# EasyEDA Pro project 一堆模块~.eprj

# Schematic Schematic1
Create Date: 2024-07-19; Page Name: P1; Project Name: 一堆模块~; Schematic Name: Schematic1; Update Date: 2024-07-19; Company: 嘉立创EDA; Page Size: A4; Version: V1.0
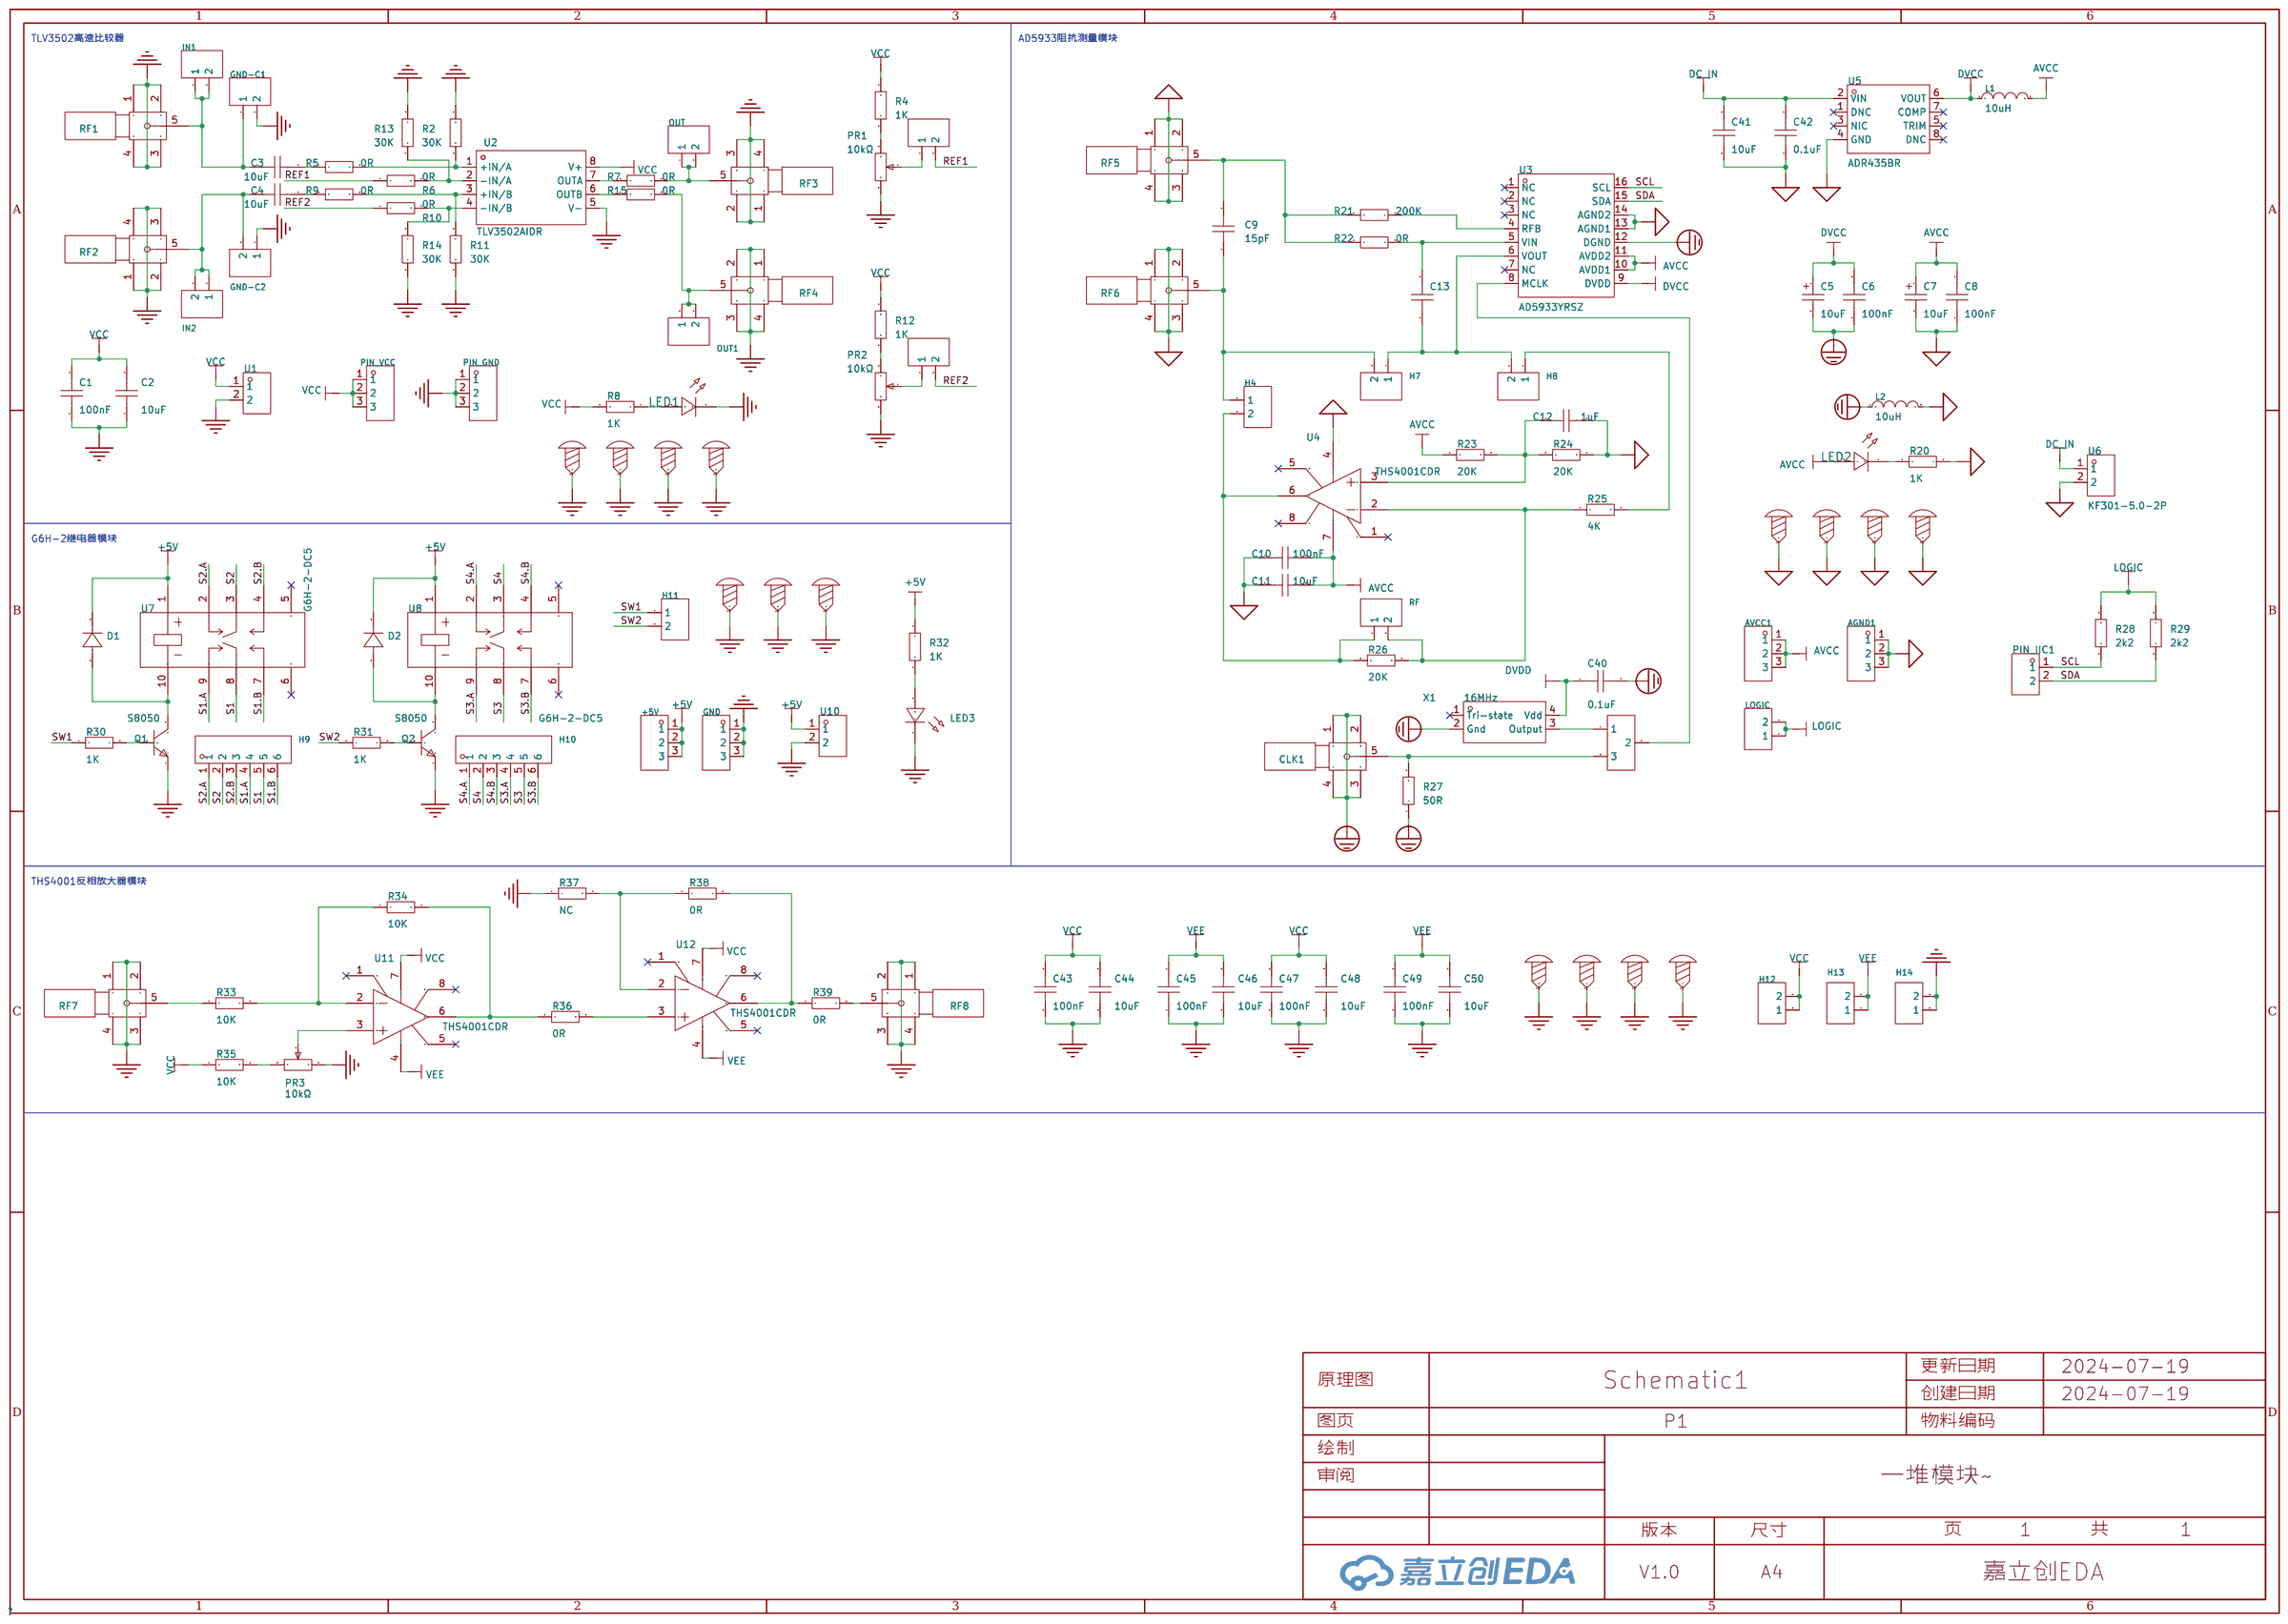
[diagram p0: schematic sheet]

## Parts
+5V  -  [HDR-TH_3P-P2.54-V-F]
AGND1  -  [HDR-TH_3P-P2.54-V-F]
AVCC1  -  [HDR-TH_3P-P2.54-V-F]
C1  100nF  [C0603]
C2  10uF  [C0603]
C3  10uF  [C0603]
C4  10uF  [C0603]
C5  10uF  [CAP-SMD_L3.2-W1.6-RD-C7171]
C6  100nF  [C0603]
C7  10uF  [CAP-SMD_L3.2-W1.6-RD-C7171]
C8  100nF  [C0603]
C9  15pF  [C0603]
C10  100nF  [C0603]
C11  10uF  [C0603]
C12  1uF  [C0603]
C13  100nF  [C0603]
C40  0.1uF  [C0603]
C41  10uF  [C0603]
C42  0.1uF  [C0603]
C43  100nF  [C0603]
C44  10uF  [C0603]
C45  100nF  [C0603]
C46  10uF  [C0603]
C47  100nF  [C0603]
C48  10uF  [C0603]
C49  100nF  [C0603]
C50  10uF  [C0603]
CLK1  BWSMA-KE-Z001  [SMA-TH_BWSMA-KE-Z001]
D1  -  [DO_1N4007]
D2  -  [DO_1N4007]
GND  -  [HDR-TH_3P-P2.54-V-F]
GND-C1  -  [HDR-TH_2P-P2.54-V-F]
GND-C2  -  [HDR-TH_2P-P2.54-V-F]
H1  -  [HDR-TH_2P-P2.54-V-F]
H2  -  [HDR-TH_2P-P2.54-V-F]
H4  -  [HDR-TH_2P-P2.54-V-F]
H6  2.54-1*3P针  [HDR-TH_3P-P2.54-V-M-1]
H7  -  [HDR-TH_2P-P2.54-V-F]
H8  -  [HDR-TH_2P-P2.54-V-F]
H9  -  [HDR-TH_6P-P2.54-V-F]
H10  -  [HDR-TH_6P-P2.54-V-F]
H11  -  [HDR-TH_2P-P2.54-V-F]
H12  -  [HDR-TH_2P-P2.54-V-F]
H13  -  [HDR-TH_2P-P2.54-V-F]
H14  -  [HDR-TH_2P-P2.54-V-F]
IN1  -  [HDR-TH_2P-P2.54-V-F]
IN2  -  [HDR-TH_2P-P2.54-V-F]
L1  10uH  [L0603]
L2  10uH  [L0603]
LED1  -  [LED_0603]
LED2  -  [LED_0603]
LED3  -  [LED_TH-3mm]
LOGIC  -  [HDR-TH_2P-P2.54-V-F]
OUT  -  [HDR-TH_2P-P2.54-V-F]
OUT1  -  [HDR-TH_2P-P2.54-V-F]
PIN_GND  -  [HDR-TH_3P-P2.54-V-F]
PIN_IIC1  ZX-XH2.54-2PZZ  [CONN-TH_2P-P2.50_HX25003-2A]
PIN_VCC  -  [HDR-TH_3P-P2.54-V-F]
PR1  10kΩ  [R_3296]
PR2  10kΩ  [R_3296]
PR3  10kΩ  [R_3296]
Q1  S8050  [TO-92-3_L4.5-W3.5-P1.27-L]
Q2  S8050  [TO-92-3_L4.5-W3.5-P1.27-L]
R2  30K  [R0603]
R4  1K  [R0603]
R5  0R  [R0603]
R6  0R  [R0603]
R7  0R  [R0603]
R8  1K  [R0603]
R9  0R  [R0603]
R10  0R  [R0603]
R11  30K  [R0603]
R12  1K  [R0603]
R13  30K  [R0603]
R14  30K  [R0603]
R15  0R  [R0603]
R20  1K  [R0603]
R21  200K  [R0603]
R22  0R  [R0603]
R23  20K  [R0603]
R24  20K  [R0603]
R25  4K  [R0603]
R26  20K  [R0603]
R27  50R  [R0603]
R28  2k2  [R0603]
R29  2k2  [R0603]
R30  1K  [Res_1/4W]
R31  1K  [Res_1/4W]
R32  1K  [Res_1/4W]
R33  10K  [R0603]
R34  10K  [R0603]
R35  10K  [R0603]
R36  0R  [R0603]
R37  NC  [R0603]
R38  0R  [R0603]
R39  0R  [R0603]
RF  -  [HDR-TH_2P-P2.54-V-F]
RF1  BWSMA-KE-Z001  [SMA-TH_BWSMA-KE-Z001]
RF2  BWSMA-KE-Z001  [SMA-TH_BWSMA-KE-Z001]
RF3  BWSMA-KE-Z001  [SMA-TH_BWSMA-KE-Z001]
RF4  BWSMA-KE-Z001  [SMA-TH_BWSMA-KE-Z001]
RF5  BWSMA-KE-P001  [SMA-SMD_BWSMA-KE-P001]
RF6  BWSMA-KE-P001  [SMA-SMD_BWSMA-KE-P001]
RF7  BWSMA-KE-P001  [SMA-SMD_BWSMA-KE-P001]
RF8  BWSMA-KE-P001  [SMA-SMD_BWSMA-KE-P001]
TP1  -  [M3螺丝]
TP2  -  [M3螺丝]
TP3  -  [M3螺丝]
TP4  -  [M3螺丝]
TP5  -  [M3螺丝]
TP6  -  [M3螺丝]
TP7  -  [M3螺丝]
TP8  -  [M3螺丝]
TP9  -  [M3螺丝]
TP10  -  [M3螺丝]
TP12  -  [M3螺丝]
TP13  -  [M3螺丝]
TP14  -  [M3螺丝]
TP15  -  [M3螺丝]
TP16  -  [M3螺丝]
U1  KF301-5.0-2P  [CONN-TH_P5.00_KF301-5.0-2P]
U2  TLV3502AIDR  [SOIC-8_L4.9-W3.9-P1.27-LS6.0-BL]
U3  AD5933YRSZ  [SSOP-16_L6.2-W5.3-P0.65-LS7.8-BL]
U4  THS4001CDR  [SOIC-8_L4.9-W3.9-P1.27-LS6.0-BL]
U5  ADR435BR  [SOIC-8_L4.9-W3.9-P1.27-LS6.0-BL]
U6  KF301-5.0-2P  [CONN-TH_P5.00_KF301-5.0-2P]
U7  G6H-2-DC5  [RELAY-TH_G6H-2]
U8  G6H-2-DC5  [RELAY-TH_G6H-2]
U10  KF301-5.0-2P  [CONN-TH_P5.00_KF301-5.0-2P]
U11  THS4001CDR  [SOIC-8_L4.9-W3.9-P1.27-LS6.0-BL]
U12  THS4001CDR  [SOIC-8_L4.9-W3.9-P1.27-LS6.0-BL]
X1  16MHz  [OSC-SMD_4P-L3.2-W2.5-BL]

## Library data of the parts
+5V AGND1 AVCC1 GND PIN_GND PIN_VCC = HDR-F_2.54_1x3P: Supplier Part: C541850; Supplier Footprint: 插件
C1-C4 C6 C8-C13 C40-C50 = CAP_0603: Supplier Footprint: 0603
C5 C7 = TAJA106K016RNJ: 容值:10uF;精度:±10%;额定电压:16V;等效串联电阻:3Ω@100kHz;; LCSC Part Name: 10uF ±10% 16V; Supplier Part: C7171; Manufacturer: Kyocera AVX; Supplier Footprint: CASE-A-3216; JLCPCB Part Class: 基础库; Datasheet: https://atta.szlcsc.com/upload/public/pdf/source/20160107/1457707750344.pdf; Supplier: LCSC; Tolerance: ±10%; Rated Voltage: 16V; Equivalent Series Resistance(ESR): 3Ω@100kHz; Operating Temperature: -55℃~+125℃
CLK1 = BWSMA-KE-Z001_C496549: 连接器类型:板端;接口类型:内孔;端口数量:1;接口直径:-;接口长度/高度:-;频率-最大值:-;射频系列:SMA;阻抗:50Ω;样式:正脚;触头材质:-;触头镀层:-;工作温度范围:-65℃~+165℃;焊接温度(最大值):-;; LCSC Part Name: 内孔 SMA 正脚; Supplier Part: C496549; Manufacturer: BAT WIRELESS(蝙蝠无线); Supplier Footprint: 插件; JLCPCB Part Class: 扩展库; Datasheet: https://atta.szlcsc.com/upload/public/pdf/source/20221228/40BF41E56A06003A0210E1785CA66EA6.pdf; Supplier: LCSC; Connector Type: 板端; Interface Type: 内孔; Number of Ports: 1; RF Series: SMA; Impedance: 50Ω; Style: 正脚; Operating Temperature Range: -65℃~+165℃
D1 D2 = D_1N4007A: Supplier Footprint: DO-41
GND-C1 GND-C2 H1 H2 H4 H7 H8 H11-H14 IN1 IN2 LOGIC OUT OUT1 RF = HDR-F_2.54_1x2P: Supplier Part: C49661; Supplier Footprint: 插件
H6 = 2.54-1*3P针: 插针结构:1x3P;间距:2.54mm;行距:-;圆针/方针:方针;安装类型:直插;排数:单排;总PIN位数:3P;额定电流:3A;额定电压:-;配合针长度:-;塑高:-;端接针长度:-;触头材质:-;触头镀层:-;工作温度范围:-40℃~+105℃;颜色:黑色;; LCSC Part Name: 间距:2.54mm 1x3P 直插 方针; Supplier Part: C49257; Manufacturer: BOOMELE(博穆精密); Supplier Footprint: 插件,P=2.54mm; JLCPCB Part Class: 扩展库; Datasheet: https://atta.szlcsc.com/upload/public/pdf/source/20221018/3E9408392E35E6F57A28985E5F7BF5C9.pdf; Supplier: LCSC; Pin Structure: 1x3P; Pitch: 2.54mm; Circluar Pins/Square Pins: 方针; Mounting Type: 直插; Number of Rows: 单排; Number of Pins: 3P; Current Rating (Max): 3A; Operating Temperature Range: -40℃~+105℃; Color: 黑色
H9 H10 = HDR-F_2.54_1x6P: Supplier Part: C40877; Supplier Footprint: 插件
L1 L2 = L_0603
LED1 LED2 = LED_0603-R: Supplier Footprint: 0603
LED3 = LED_TH-R_3mm: Supplier Footprint: 插件
PIN_IIC1 = ZX-XH2.54-2PZZ: 插针结构:1x2P;间距:2.54mm;安装方式:直插;参考系列:XH;总PIN数:2P;排数:1;每排PIN数:2;行距:-;额定电流:3A;触头材质:黄铜;触头镀层:锡;工作温度范围:-25℃~+85℃;; Supplier Part: C7429632; Manufacturer: Megastar(兆星); Supplier Footprint: 插件,P=2.54mm; JLCPCB Part Class: 扩展库; Datasheet: https://atta.szlcsc.com/upload/public/pdf/source/20230619/19BA6947230AA44A04D3EDD65E618FD0.pdf; Supplier: LCSC; Pins Structure: 1x2P; Pitch: 2.54mm; Mounting Style: 直插; Reference Series: XH; Number of Pins: 2P; Number of Rows: 1; Number of PINs Per Row: 2; Current Rating (Max): 3A; Contact Material: 黄铜; Contact Plating: 锡; Operating Temperature Range: -25℃~+85℃
PR1-PR3 = R_3296: Supplier Footprint: 直插
Q1 Q2 = S8050_C2931492: 晶体管类型:NPN;集电极电流(Ic):500mA;集射极击穿电压(Vceo):25V;功率(Pd):625mW;直流电流增益(hFE@Ic,Vce):160@50mA,1V;; LCSC Part Name: NPN 电流:500mA 耐压:25V; Supplier Part: C2931492; Manufacturer: JSMSEMI(杰盛微); Supplier Footprint: TO-92-3; JLCPCB Part Class: 扩展库; Datasheet: https://atta.szlcsc.com/upload/public/pdf/source/20240105/D4E57AD221AC7DEA1E31B953388D993E.pdf; Supplier: LCSC; Transistor Type: NPN; Collector Current (Ic): 500mA; Collector-Emitter Breakdown Voltage (Vceo): 25V; Power Dissipation (Pd): 625mW; DC Current Gain (hFE@Ic,Vce): 160@50mA,1V; Transition Frequency (fT): 150MHz; Collector Cut-Off Current (Icbo): 100nA; Collector-Emitter Saturation Voltage (VCE(sat)@Ic,Ib): 600mV@500mA,50mA
R2 R4-R15 R20-R29 R33-R39 = Res_0603: Supplier Footprint: 0603
R30-R32 = Res_AXIAL-1/4W: Supplier Footprint: 轴向引线
RF1-RF4 = BWSMA-KE-Z001_C496549: 连接器类型:板端;接口类型:内孔;端口数量:1;接口直径:-;接口长度/高度:-;频率-最大值:-;射频系列:SMA;阻抗:50Ω;样式:正脚;触头材质:-;触头镀层:-;工作温度范围:-65℃~+165℃;焊接温度(最大值):-;; LCSC Part Name: 内孔 SMA 正脚; Supplier Part: C496549; Manufacturer: BAT WIRELESS(蝙蝠无线); Supplier Footprint: 插件; JLCPCB Part Class: Extended Part; Datasheet: https://atta.szlcsc.com/upload/public/pdf/source/20221228/40BF41E56A06003A0210E1785CA66EA6.pdf; Supplier: LCSC; Connector Type: 板端; Interface Type: 内孔; Number of Ports: 1; RF Series: SMA; Impedance: 50Ω; Style: 正脚; Operating Temperature Range: -65℃~+165℃
RF5-RF8 = BWSMA-KE-P001: 连接器类型:板端;接口类型:内孔;端口数量:1;接口直径:5.2mm;接口长度/高度:-;频率-最大值:-;射频系列:SMA;阻抗:50Ω;样式:偏脚;工作温度范围:-;; LCSC Part Name: 内孔 SMA 偏脚; Supplier Part: C496550; Manufacturer: BAT WIRELESS(蝙蝠无线); Supplier Footprint: 插件; JLCPCB Part Class: Extended Part; Datasheet: https://atta.szlcsc.com/upload/public/pdf/source/20240320/28FD502871C976DFF213ABFCF2A0ED51.pdf; Supplier: LCSC; Connector Type: 板端; Interface Type: 内孔; Number of Ports: 1; Interface Diameter: 5.2mm; RF Series: SMA; Impedance: 50Ω; Style: 偏脚
TP1-TP10 TP12-TP16 = M3螺丝: Supplier Footprint: 插件
U1 U6 U10 = KF301-5.0-2P: 结构:1x2P;间距:5mm;颜色:蓝色;安装方式:直插;额定电流:17A;额定电压:250V;排数:1;线规 - AWG:14~22;线规 - 平方毫米:1.5;每排PIN数:2;工作温度范围:-30℃~+120℃;; LCSC Part Name: 5mm 1x2P 排数:1 每排P数:2 直插; Supplier Part: C474881; Manufacturer: KEFA(科发); Supplier Footprint: 插件,P=5mm; JLCPCB Part Class: Extended Part; Datasheet: https://atta.szlcsc.com/upload/public/pdf/source/20230317/03A5B5FC229D6F9225E8F51DA1A4E80A.pdf; Supplier: LCSC; Structure: 1x2P; Pitch: 5mm; Color: 蓝色; Mounting Style: 直插; Current Rating (Max): 17A; Voltage Rating (Max): 250V; Number of Pins: 2P; Number of Rows: 1; Wire Gauge - AWG: 14~22; Wire Gauge - mm2: 1.5; Number of PINs Per Row: 2; Operating Temperature Range: -30℃~+120℃
U2 = TLV3502AIDR: 输入失调电压(Vos):6.5mV;输入偏置电流(Ib):10pA;; Supplier Part: C131165; Manufacturer: TI(德州仪器); Supplier Footprint: SOIC-8; JLCPCB Part Class: 扩展库; Datasheet: https://www.ti.com/cn/lit/gpn/tlv3501; Supplier: LCSC; Input Offset Voltage (Vos): 6.5mV; Input Bias Current (Ib): 10pA; Propagation Delay Time: 10ns; Input Hysteresis Voltage (Vhys): 6mV; Common Mode Rejection Ratio (CMRR): 70dB; Supply Voltage: 1.35V~2.75V；2.7V~5.5V; Output Type: 推挽; Output Mode: TTL；CMOS; Supply Current: 5mA; Operating Temperature: -40℃~+125℃
U3 = AD5933YRSZ: 自宽调谐(最大值):-;; Supplier Part: C578324; Manufacturer: ADI(亚德诺); Supplier Footprint: SSOP-16-208mil; JLCPCB Part Class: 扩展库; Datasheet: https://atta.szlcsc.com/upload/public/pdf/source/20210224/C578324_9EDCF4E5C1159F060079EFC2100F36DA.pdf; Supplier: LCSC
U4 U11 U12 = THS4001CDR: 放大器数:单路;增益带宽积(GBP):270MHz;输入偏置电流(Ib):2.6uA;压摆率(SR):400V/us;带宽(-3db):270MHz;; Supplier Part: C2060779; Manufacturer: TI(德州仪器); Supplier Footprint: SOIC-8; JLCPCB Part Class: 扩展库; Datasheet: https://www.ti.com/cn/lit/gpn/ths4001; Supplier: LCSC; Number of Circuits: 单路; Gain Bandwidth Product(GBP): 270MHz; Current - Input Bias(Ib): 2.6uA; Slew Rate(SR): 400V/us; Output Current: 100mA; -3db Bandwidth: 270MHz; Operating Temperature: 0℃~+70℃
U5 = ADR435BR: Supplier Part: C3680304; Manufacturer: ADI(亚德诺); Supplier Footprint: SOIC-8; JLCPCB Part Class: 扩展库; Datasheet: https://atta.szlcsc.com/upload/public/pdf/source/20231009/7D255AA10026D43B5E3A241EEF1EF25C.pdf; Supplier: LCSC
U7 U8 = G6H-2-DC5: Supplier Part: C19589425; Manufacturer: OMRON(欧姆龙); Datasheet: https://atta.szlcsc.com/upload/public/pdf/source/20190627/C397203_AB02BC1D2134B98F8B449610479358D8.pdf; Supplier: LCSC
X1 = ECS-3225MV-160-CN-TR: 频率:16MHz;输出模式:HCMOS;工作电压:1.62V~3.63V;供电电流:4mA;频率稳定度(全温):±25ppm;; Supplier Part: C405476; Manufacturer: ECS; Supplier Footprint: SMD3225-4P; JLCPCB Part Class: 扩展库; Datasheet: https://atta.szlcsc.com/upload/public/pdf/source/20190722/C405974_E391C371A04B2657C74E5C75332D4B2B.pdf; Supplier: LCSC; Output Type: HCMOS; Supply Voltage: 1.62V~3.63V; Supply Current (Max): 4mA; Frequency Stability(Full temperature range): ±25ppm; Operating Temperature: -40℃~+85℃

## Nets
+5V: +5V.1 +5V.2 +5V.3 D1.1(K) D2.1(K) R32.2 U7.1 U8.1 U10.1
AGND: AGND1.1 AGND1.2 AGND1.3 C7.2 C8.1 C10.1 C11.1 C12.2 C41.1 C42.1 L2.2 R20.1 R24.2 RF5.1 RF5.2 RF5.3 RF5.4 RF6.1 RF6.2 RF6.3 RF6.4 TP5.1 TP6.1 TP7.1 TP8.1 U3.13(AGND1) U3.14(AGND2) U4.4(VCC-) U5.4(GND) U6.2
AVCC: AVCC1.1 AVCC1.2 AVCC1.3 C7.1 C8.2 C10.2 C11.2 L1.2 LED2.2(A) R23.1 U3.10(AVDD1) U3.11(AVDD2) U4.7(VCC+)
DVCC: C5.1 C6.2 L1.1 U3.9(DVDD) U5.6(VOUT)
DVDD: C40.1 X1.4(Vdd)
GND: C1.1 C2.1 C43.1 C44.1 C45.1 C46.1 C47.1 C48.1 C49.1 C50.1 GND.1 GND.2 GND.3 GND-C1.2 GND-C2.1 H14.1 H14.2 LED1.1(C) LED3.2(A) PIN_GND.1 PIN_GND.2 PIN_GND.3 PR1.1 PR2.1 PR3.1 Q1.1(E) Q2.1(E) R2.2 R11.2 R13.2 R14.2 R37.1 RF1.1 RF1.2 RF1.3 RF1.4 RF2.1 RF2.2 RF2.3 RF2.4 RF3.1 RF3.2 RF3.3 RF3.4 RF4.1 RF4.2 RF4.3 RF4.4 RF7.1 RF7.2 RF7.3 RF7.4 RF8.1 RF8.2 RF8.3 RF8.4 TP1.1 TP2.1 TP3.1 TP4.1 TP9.1 TP10.1 TP12.1 TP13.1 TP14.1 TP15.1 TP16.1 U1.2 U2.5(V-) U10.2
PGND: C5.2 C6.1 C40.2 CLK1.1 CLK1.2 CLK1.3 CLK1.4 L2.1 R27.1 U3.12(DGND) X1.2(Gnd)
VCC: C1.2 C2.2 C43.2 C44.2 C47.2 C48.2 H12.1 H12.2 PIN_VCC.1 PIN_VCC.2 PIN_VCC.3 R4.1 R8.2 R12.1 R35.1 U1.1 U2.8(V+) U11.7(VCC+) U12.7(VCC+)
VEE: C45.2 C46.2 C49.2 C50.2 H13.1 H13.2 U11.4(VCC-) U12.4(VCC-)
DC_IN: C41.2 C42.2 U5.2(VIN) U6.1
LOGIC: LOGIC.1 LOGIC.2 R28.2 R29.2
REF1: H1.2 R6.1
REF2: H2.2 R10.1
S1: H9.5 U7.8
S1.A: H9.4 U7.9
S1.B: H9.6 U7.7
S2: H9.2 U7.3
S2.A: H9.1 U7.2
S2.B: H9.3 U7.4
S3: H10.5 U8.8
S3.A: H10.4 U8.9
S3.B: H10.6 U8.7
S4: H10.2 U8.3
S4.A: H10.1 U8.2
S4.B: H10.3 U8.4
SCL: PIN_IIC1.1 R28.1 U3.16(SCL)
SDA: PIN_IIC1.2 R29.1 U3.15(SDA)
SW1: H11.1 R30.1
SW2: H11.2 R31.1
$1N799: PR1.3 R4.2
$1N1389: R7.1 U2.7(OUTA)
$1N1441: OUT.1 OUT.2 R7.2 RF3.5
$1N1870: LED1.2(A) R8.1
$1N2711: C3.2 R5.1
$1N2723: R2.1 R5.2 U2.1(+IN/A)
$1N2769: R9.2 R11.1 U2.3(+IN/B)
$1N2791: H1.1 PR1.2
$1N2928: PR2.3 R12.2
$1N2932: H2.1 PR2.2
$1N3021: R10.2 R14.1 U2.4(-IN/B)
$1N3030: R6.2 R13.1 U2.2(-IN/A)
$1N3129: C4.2 R9.1
$1N3385: R15.1 U2.6(OUTB)
$1N3388: OUT1.1 OUT1.2 R15.2 RF4.5
$1N3561: C3.1 GND-C1.1 IN1.1 IN1.2 RF1.5
$1N3582: C4.1 GND-C2.2 IN2.1 IN2.2 RF2.5
$1N4588: H6.2 U3.8(MCLK)
$1N4608: LED2.1(C) R20.2
$1N4821: R21.2 U3.4(RFB)
$1N8057: C9.2 R21.1 R22.1 RF5.5
$1N8729: C12.1 R23.2 R24.1 U4.3(IN+)
$1N8955: C13.2 R22.2 U3.5(VIN)
$1N11254: H6.1 X1.3(Output)
$1N11257: CLK1.5 H6.3 R27.2
$1N12100: H8.1 R25.2
$1N12125: C9.1 H4.1 H7.2 RF6.5
$1N12149: C13.1 H7.1 H8.2 U3.6(VOUT)
$1N13153: Q1.2(B) R30.2
$1N13341: Q2.2(B) R31.2
$1N14258: D2.2(A) Q2.3(C) U8.10
$1N14277: D1.2(A) Q1.3(C) U7.10
$1N14424: LED3.1(C) R32.1
$1N14988: R33.2 R34.1 U11.2(IN-)
$1N15115: PR3.2 U11.3(IN+)
$1N15150: PR3.3 R35.2
$1N15380: R33.1 RF7.5
$1N15473: R34.2 R36.1 U11.6(OUT)
$1N16065: R36.2 U12.3(IN+)
$1N16070: R37.2 R38.1 U12.2(IN-)
$1N16122: R38.2 R39.1 U12.6(OUT)
$1N16128: R39.2 RF8.5
Net-(H4-2): H4.2 R26.1 RF.1 U4.6(OUT)
Net-(R25-1): R25.1 R26.2 RF.2 U4.2(IN-)

Not connected (* = marked no-connect by the designer): U3 1(NC)* 2(NC)* 3(NC)* 7(NC)*; U4 1(NULL)* 5(NC)* 8(NULL)*; U5 1(DNC)* 3(NIC)* 5(TRIM)* 7(COMP)* 8(DNC)*; U7 5* 6*; U8 5* 6*; U11 1(NULL)* 5(NC)* 8(NULL)*; U12 1(NULL)* 5(NC)* 8(NULL)*; X1 1(Tri-state)*

## Notes on the sheet
- TLV3502高速比较器
- AD5933阻抗测量模块
- G6H-2继电器模块
- THS4001反相放大器模块

# Board PCB1